# EAGLE board BMS-HVver3 (EAGLE 6.6.0), part 2 of 2
## Tracks (layer width: path | path; a pad name or v marks a point on that pad's centre or on a via) (continued)
N$56  (via drill 0.6) (continued)
  other vias: 1.92,102.02
N$57
  Top 0.61: D25.C 5.7,98.88 R156.2
N$58
  Top 0.178: R153.1 F2.2 | Q24.2 20,102.54 20.19,102.74
  Top 0.61: R156.1 7.82,98.9 7.92,99 7.92,101.62 R1.1 8.24,102.74 20.19,102.74 20.9,102.74 21.87,103.7 F2.2
N$59
  Top 0.178: Q24.1 20.23,99.5 20.37,99.36 25.85,99.36 R155.1
N$60
  Top 0.305: D26.A 2.12,94.53 R148.2
  Top 0.813: R148.2 2.1,96.38 2.95,97.22 9.7,97.22 12.9,100.42 17.87,100.42 Q24.3
N$61
  Top 0.305: D26.C R157.2
N$62  (via drill 0.6)
  Top 0.178: R152.1 28.63,97.2 v29.08,97.3
  Top 0.305: R157.1 R148.1
  Top 0.61: Q23.2 20.03,97.21 v20.02,97.22
  Top 0.813: R148.1 9.88,94.55 12.55,97.22 v20.02,97.22
  Bottom 0.61: F3.2 v29.08,97.3 20.98,97.3 20.9,97.22 v20.02,97.22
N$63
  Top 0.178: Q23.1 22.48,93.89 R159.1
N$64
  Top 0.305: D27.A 2.12,86.89 R189.2
  Top 0.813: R189.2 2.1,89.09 2.77,89.76 9.17,89.76 14.33,94.91 17.85,94.91 Q23.3
N$65
  Top 0.305: D27.C 5.98,83.79 R160.2
N$66
  Top 0.178: R158.1 19.99,86.3 Q22.2
  Top 0.305: R160.1 R189.1
  Top 0.813: F4.2 20.12,88.61 19.84,88.33 19.84,87.98 | 19.84,87.98 19.84,86.37 Q22.2 | R189.1 7.7,87.4 8.1,87.8 19.66,87.8 19.84,87.98
N$67
  Top 0.178: R162.1 20.01,84.42 Q22.1
N$68
  Top 0.305: D28.A 2.25,79.06 R190.2
  Top 0.813: R190.2 2.28,81.44 2.95,82.11 9.35,82.11 12.55,85.31 Q22.3
N$69
  Top 0.305: D28.C R163.2
N$70  (via drill 0.6)
  Top 0.178: R161.1 20.14,79.9 Q21.2
  Top 0.305: R163.1 7.89,78.16 8.28,78.56 8.28,78.69 R190.1
  Top 0.813: Q21.2 20.19,79.95 v20.19,81.4 20.02,81.22 11.3,81.22 9.17,79.09 R190.1
  Bottom 0.813: F5.2 20.9,79.98 20.19,80.69 v20.19,81.4
N$71
  Top 0.178: R165.1 20.29,77.72 Q21.1
N$72
  Top 0.305: D29.A 2.25,70.75 2.41,70.91 2.41,71.49 R191.2
  Top 0.813: R191.2 2.28,73.62 3.12,74.47 9.35,74.47 13.79,78.91 17.95,78.91 Q21.3
N$73
  Top 0.305: D29.C R166.2
N$74
  Top 0.178: R168.1 19.96,61.61 Q19.1
N$75
  Top 0.305: D30.A 2.25,56.17 2.41,56.33 2.41,56.73 R193.2
  Top 0.813: 2.41,56.73 2.41,58.82 3.12,59.53 9.35,59.53 12.19,62.38 17.67,62.38 Q19.3
N$76
  Top 0.305: R169.2 D30.C
N$77
  Top 0.178: Q20.2 21.23,68.56 R164.1
  Top 0.305: R166.1 R191.1
  Top 0.813: F6.2 20.19,71.09 19.84,70.73 | 19.84,70.73 19.66,70.55 19.66,68.62 Q20.2 | R166.1 7.89,71.23 8.1,71.44 19.13,71.44 19.84,70.73
N$78
  Top 0.178: Q20.1 21.44,66.66 R171.1
N$79
  Top 0.305: D31.A 2.25,64.12 R192.2
  Top 0.813: R192.2 2.28,66.15 3.12,67 10.06,67 10.77,67.71 17.52,67.71 Q20.3
N$80
  Top 0.305: D31.C R172.2
N$81  (via drill 0.6)
  Top 0.178: R170.1 19.66,64.51 v19.3,64.86
  Top 0.305: R172.1 R192.1
  Top 0.813: Q19.2 19.3,63.94 v19.3,64.86 19.13,64.69 7.75,64.69 7.89,64.55 R192.1
  Bottom 0.813: F7.2 31.32,62.45 30.51,63.26 20.9,63.26 v19.3,64.86
N$82
  Top 0.178: R167.1 21.48,53.56 F8.2
  Top 0.305: R169.1 R193.1
  Top 0.813: F8.2 20.48,53.6 20.1,53.22 | 20.1,53.22 20.02,53.13 20.02,51.35 Q18.2 | R169.1 7.89,56.65 7.92,56.69 18.06,56.69 19.48,55.26 19.48,53.84 20.1,53.22
N$83
  Top 0.178: Q18.1 21.46,49.41 R174.1
N$84
  Top 0.305: D32.A 2.25,49.37 R194.2
  Top 0.813: R194.2 2.28,51.57 2.77,52.06 12.01,52.06 13.79,50.28 17.8,50.28 Q18.3
N$85
  Top 0.305: D32.C R175.2
N$86  (via drill 0.6)
  Top 0.178: R173.1 20.37,44.52 Q17.2
  Top 0.305: R175.1 R194.1
  Top 0.813: Q17.2 20.37,44.52 v20.37,45.84 18.95,47.26 12.01,47.26 10.41,48.86 7.92,48.86 7.89,48.82 R175.1
  Bottom 0.813: F9.2 20.99,44.86 20.37,45.48 v20.37,45.84
N$87
  Top 0.178: R177.1 20.22,42.44 Q17.1
N$88
  Top 0.305: D33.A 2.25,41.72 R195.2
  Top 0.813: R195.2 2.28,43.93 2.95,44.59 12.01,44.59 13.26,43.35 18.05,43.35 Q17.3
N$89
  Top 0.305: D33.C R178.2
N$90
  Top 0.178: R176.1 21.48,36.05 F10.2
  Top 0.305: R178.1 R195.1
  Top 0.813: F10.2 20.59,36.1 20.19,35.7 20.19,35.53 | 20.19,35.53 20.19,33.67 Q15.2 | R178.1 7.89,41.26 7.75,41.39 14.68,41.39 16.82,39.26 16.82,36.24 17.35,35.7 20.02,35.7 20.19,35.53
N$91
  Top 0.178: R180.1 20.17,31.72 Q15.1
N$92
  Top 0.305: D34.A 2.25,34.25 R196.2
  Top 0.813: D34.A 2.25,36.25 2.77,36.77 13.08,36.77 14.5,35.35 14.5,33.57 15.39,32.68 Q15.3
N$93
  Top 0.305: D34.C R181.2
N$94  (via drill 0.6)
  Top 0.178: R179.1 20.19,27.42 Q14.2
  Top 0.305: R181.1 R196.1
  Top 0.813: Q14.2 20.19,27.42 v20.19,29.13 13.08,29.13 11.48,30.73 11.48,33.57 10.59,34.46 8.06,34.46 R196.1
  Bottom 0.813: F11.2 32.31,28.03 31.22,29.13 v20.19,29.13
N$95
  Top 0.178: R183.1 20.19,25.44 Q14.1
N$96
  Top 0.305: D35.A 2.25,26.79 R197.2
  Top 0.813: R197.2 2.28,28.82 2.95,29.48 10.95,29.48 13.97,26.46 18.03,26.46 Q14.3
N$97
  Top 0.305: D35.C R184.2
N$98
  Top 0.178: Q16.1 23.47,12.33 R186.1
N$99
  Top 0.254: D36.C 27.93,6.09 R187.2
N$100
  Top 0.178: R151.1 33.5,109.14
  Top 0.305: F1.2 33.5,110.27 33.5,109.14 34.6,109.14 35.31,108.42 35.31,102.02 32.28,99 32.28,89.22 32.68,88.83 R149.1 33.26,86.99 R150.1
  Top 0.61: F1.2 31.47,110.58 Q25.2
N$101
  Top 0.254: D36.A 24.07,9.29 R198.2
  Top 0.813: R198.2 21.26,9.39 20.02,10.63 20.02,13.22 Q16.3
N$102
  Top 0.254: R79.1 74.72,109.62 Q38.1
N$103
  Top 0.254: D8.A 53.03,102.02 R114.2
  Top 0.813: Q38.3 53.98,110.51 52.96,109.49 52.96,102.15 R114.2
N$104
  Top 0.254: D8.C 56.91,99.1 R81.2
N$105
  Top 0.178: U$14.1 34.87,13.39 R185.1
  Top 0.254: R187.1 29.65,9.31 R198.1
  Top 0.813: U$14.1 32.48,11.12 R188.1 32.3,11.17 30.33,11.17 29.57,10.41 R198.1
N$106
  Top 0.178: Q16.2 23.53,14.23 R182.1
  Top 0.305: R184.1 R197.1
  Top 0.813: F12.2 22.31,16.13 21.97,15.79 | 21.97,15.79 21.97,14.31 Q16.2 | 21.97,15.79 21.97,22.37 21.08,23.26 13.26,23.26 9.7,26.81 R197.1
N$107
  Top 0.61: R149.2 34.96,90.37 C64.1 35.1,90.58 35.1,91.66 35.61,92.17 43.05,92.17 43.35,91.88 U$28.P$2
N$108
  Top 0.178: R78.1 66.34,103.9 Q37.2
  Top 0.254: R81.1 58.64,102.03 R114.1
  Top 0.813: F14.2 66.29,106.06 66.04,105.81 66.04,104.79 | 66.04,104.79 66.04,103.82 Q37.2 | R114.1 58.66,104.27 59.06,104.67 65.91,104.67 66.04,104.79
N$109
  Top 0.305: D37.A R54.1
N$110
  Top 0.178: R80.1 67.6,101.78 67.82,102 66.42,102 66.29,101.87 66.29,101.75 66.17,101.62 66.17,102 66.04,102.13 66.04,101.92 Q37.1
N$111
  Top 0.254: D14.A 53.18,94.64 R115.2
  Top 0.813: R115.2 53.13,96.84 53.72,97.43 59.82,97.43 60.83,98.44 60.83,101.87 62.23,102.76 Q37.3
N$112
  Top 0.254: D14.C R82.2
N$113  (via drill 0.6)
  Top 0.178: R77.1 66.09,97.3 | 65.91,97.3 66.09,97.3 | 66.09,97.3 Q36.2
  Top 0.254: R82.1 58.76,94.65 R115.1
  Top 0.813: v66.67,98.95 66.55,98.95 66.04,98.44 66.04,98.32 | Q36.2 66.04,97.47 66.04,98.32 | 66.04,98.32 62.36,98.32 61.85,97.81 61.85,95.4 61.21,94.76 58.81,94.76 R115.1
  Bottom 0.813: F15.2 67.31,97.43 66.67,98.06 v66.67,98.95
N$114
  Top 0.305: Q26.3 43.64,50.05 R214.8 R214.7 R214.6 R214.5
N$115
  Top 0.178: Q36.1 67.61,95.46 R84.1
N$116
  Top 0.254: D15.A 53.08,83.97 53.08,87.14
  Top 0.813: R116.2 53.08,87.14 53.08,89.04 53.85,89.81 62.36,89.81 63.12,90.57 63.12,95.48 Q36.3
N$117
  Top 0.254: D15.C 56.77,83.91 56.77,83.84 56.94,83.84 | 57.15,83.84 56.94,83.84 | 56.94,83.84 R85.2
N$118
  Top 0.254: R83.1 66.15,86 Q35.2 | R85.1 58.67,83.97 58.67,86.5 58.68,86.5 R116.1
  Top 0.813: F16.2 66.42,88.66 66.17,88.41 66.17,87.9 | 66.17,87.9 66.17,85.95 Q35.2 | R116.1 58.68,87.4 59.18,87.9 66.17,87.9
N$119
  Top 0.178: Q26.1 44.59,56 R215.1 44.54,58.16 R213.1
N$120
  Top 0.178: D38.A 83.73,60.47 R55.1
N$121
  Top 0.254: R87.1 66.15,83.97 Q35.1
N$122
  Top 0.254: D16.A 53.08,76.09 R117.2
  Top 0.813: R117.2 53.08,81.16 53.85,81.93 61.21,81.93 61.98,82.69 61.98,84.47 62.48,84.98 Q35.3
N$123
  Top 0.178: 56.77,75.99 R88.2
  Top 0.254: D16.C 56.77,75.99 56.77,75.96
N$124  (via drill 0.6)
  Top 0.254: R86.1 66.32,80.33 66.32,80.13 | R88.1 58.68,76.09 R117.1
  Top 0.813: v66.42,81.42 66.42,80.66 | 66.42,80.66 66.42,80.23 66.32,80.13 Q34.2 | R117.1 58.68,79.65 58.93,79.9 59.31,79.9 59.82,80.41 66.17,80.41 66.42,80.66
  Bottom 0.813: F17.2 67.08,79.88 66.42,80.54 v66.42,81.42
N$125
  Top 0.406: J3.2 151.06,103.21 151,96.28 151,93.87 | 151,93.87 151,82.69 | 151,82.69 151,73.04 | 151,73.04 151,29.61 143.76,22.37 143.76,20.37 J4.2 | TX3.6 150.88,94 151,93.87 | TX1.6 151,82.69 | TX2.6 150.88,72.92 151,73.04
N$126
  Top 0.254: R90.1 66.15,77.87 Q34.1
N$127
  Top 0.254: D17.A 52.96,68.6 52.96,71.27 53.03,71.27 53.03,71.9 | R118.2 52.96,71.57 52.96,71.52
  Top 0.813: R118.2 53.03,71.9 53.03,73.75 53.72,74.44 61.21,74.44 62.36,75.58 62.36,78.5 62.87,79.01 Q34.3
N$128
  Top 0.178: R91.2 56.77,68.6
  Top 0.254: D17.C 56.77,68.6
N$129  (via drill 0.6)
  Top 0.406: J3.1 146.85,104.57 146.85,101.71 147.95,100.6 147.95,89.05 | 147.95,89.05 147.95,77.61 | 147.95,77.61 147.95,67.84 | 147.95,67.84 147.95,28.59 v143.76,24.4 | TX2.4 147.95,67.84 | TX1.4 147.95,77.61 | TX3.4 148.08,88.92 147.95,89.05
  Bottom 0.406: v143.76,24.4 145.8,22.37 145.8,20.41 J4.1
N$130
  Top 0.254: R93.1 66.02,61.49 Q32.1
N$131
  Top 0.305: D18.A 52.93,56.5 53.09,56.66 53,56.66 R120.2
  Top 0.813: R120.2 52.9,59.02 53.47,59.58 60.71,59.58 61.72,60.6 61.72,61.99 62.23,62.5 Q32.3
N$132
  Top 0.305: D18.C 56.52,53.74 56.64,53.87 56.68,53.87 R94.2
N$133  (via drill 0.3)
  Top 0.178: U3.35 38.8,70.52 38.53,70.25 38.53,69.56 v38.41,69.44
  Bottom 0.178: v38.41,69.44 38.41,69.03 38.08,68.7 37.3,68.7 C90.1
N$134
  Top 0.254: R91.1 58.67,68.6 58.67,71.39 58.63,71.39 R118.1 | R89.1 66.17,69.11 66.17,68.98 66.02,68.98 Q33.2
  Top 0.813: R118.1 58.73,71.57 58.93,71.77 66.08,71.77 F18.2 66.02,70.45 Q33.2
N$135  (via drill 0.3)
  Top 0.178: U1.35 129.7,70.52 v129.03,69.84
  Bottom 0.178: v129.03,69.84 127.61,69.84 C30.1
N$136
  Top 0.254: R96.1 66.02,66.95 Q33.1
N$137
  Top 0.305: D19.A 52.93,63.87 53.09,64.03 53.09,64.22 52.9,64.41
  Top 0.813: R119.2 52.9,64.41 52.9,66 53.72,66.82 60.83,66.82 61.85,67.84 63.8,67.84 Q33.3
N$138
  Top 0.305: D19.C R97.2
N$139  (via drill 0.6)
  Top 0.178: Q32.2 66.1,63.45 66.17,63.52
  Top 0.254: R95.1 66.17,63.52 65.66,63.52
  Top 0.305: R97.1 R119.1
  Top 0.813: R119.1 58.5,64.74 58.8,65.04 65.79,65.04 v65.91,65.17 66.02,65.06 Q32.2
  Bottom 0.813: v65.91,65.17 78.74,65.17 78.78,65.13 F19.2
N$140
  Top 0.254: D39.A 139.42,65.94 R56.1
N$141
  pour Top: 131.22,91.99 140.61,91.99 140.84,92.6 140.84,107.82 139.78,109.26 134.72,109.26 134.04,108.58 134.04,105.25 131.39,102.61 131.39,92.17
N$142
  Top 0.254: R92.1 67.31,51.48 67.31,51.2 66.29,51.2 66.29,51.07 66.28,51.07 Q31.2
  Top 0.305: R94.1 58.51,55.73 58.74,55.96
  Top 0.813: R120.1 58.5,56.2 58.74,55.96 58.8,55.9 62.36,55.9 63.12,55.14 63.12,53.36 63.25,53.23 66.42,53.23 | 66.42,53.23 66.59,53.23 F20.2 | Q31.2 66.28,53.09 66.42,53.23
N$144
  Top 0.254: R99.1 66.28,49.29 Q31.1
N$145
  Top 0.305: D20.A 52.8,49.4 52.78,49.42
  Top 0.813: R121.2 52.78,49.42 52.78,51.27 53.47,51.96 60.83,51.96 62.48,50.31 Q31.3
N$146
  Top 0.305: D20.C R100.2
N$147  (via drill 0.6)
  Top 0.254: R98.1 66.28,44.72 Q30.2
  Top 0.305: R100.1 58.38,48.66 | 58.38,48.66 58.38,49.51 58.67,49.8 58.67,48.91 58.55,48.79 | 58.38,48.79 58.38,48.66
  Top 0.813: R121.1 58.38,48.79 58.38,48.58 58.55,48.41 60.58,48.41 61.47,47.52 65.79,47.52 66.29,47.01 v66.29,46.5 66.28,46.48 Q30.2
  Bottom 0.813: v66.29,46.5 66.29,45.36 66.67,44.98 77.76,44.98 F21.2
N$149
  Top 0.254: R102.1 66.28,42.69 Q30.1
N$150
  Top 0.305: D21.A 52.93,41.84 52.58,42.18 52.58,42.05 R122.2
  Top 0.813: R122.2 52.9,44.03 53.47,44.59 63.29,44.59 Q30.3
N$151
  Top 0.305: D21.C R103.2
N$152
  Top 0.254: Q28.2 67.44,33.73 67.44,33.67 67.6,33.67 R101.1
  Top 0.305: R103.1 R122.1
  Top 0.813: R122.1 58.5,40.7 58.67,40.53 63.63,40.53 64.52,39.64 64.52,36.47 65.15,35.83 66.29,35.83 | 66.29,35.83 F22.2 | Q28.2 66.28,35.82 66.29,35.83
N$154
  Top 0.254: Q28.1 67.68,31.83 R105.1
N$155
  Top 0.305: D22.A 53.05,33.83 52.96,33.93 53.09,34.05 53.09,34.5 53.03,34.56
  Top 0.813: R123.2 53.03,34.56 53.03,36.28 53.72,36.98 61.72,36.98 62.61,36.09 62.61,33.16 62.99,32.78 64.05,32.76 Q28.3
N$156
  Top 0.305: D22.C R106.2
N$159  (via drill 0.6)
  Top 0.178: R104.1 66.41,27.7 66.28,27.83
  Top 0.305: R106.1 58.64,33.79 58.63,33.8
  Top 0.813: R123.1 58.63,33.8 58.63,33.34 58.67,33.29 60.71,33.29 61.21,32.78 61.21,29.86 61.85,29.23 v66.29,29.23 66.28,29.21 66.28,27.83 Q27.2
  Bottom 0.813: 66.29,28.96 v66.29,29.23 68.2,27.32 F23.2
N$161
  Top 0.254: R108.1 66.28,25.67 Q27.1
N$162
  Top 0.254: D23.A 53.09,23.77 53.09,26.81 53.03,26.81 R124.2
  Top 0.813: R124.2 53.03,28.54 53.72,29.23 59.94,29.23 62.48,26.69 Q27.3
N$163
  Top 0.254: D23.C R109.2
N$165
  Top 0.254: Q29.1 66.93,14.18 66.93,14.24 67.18,14.24 67.18,13.86 R111.1
N$166
  Top 0.254: D24.C R112.2
N$170
  Top 0.254: R75.1 77.85,104.79 80.39,107.33 80.39,111.14 79.12,112.41 76.2,112.41 76.07,112.54 76.07,113.57 F13.2 | R76.1 74.72,111.4 74.55,111.57
  Top 0.406: R75.1 79.55,94.52 R74.1
  Top 0.813: F13.2 74.85,113.61 74.55,113.3 74.55,111.57 Q38.2
N$175
  Top 0.254: D24.A 53.16,16.27 53.16,19.45
  Top 0.813: R125.2 53.16,19.45 53.16,21.3 53.85,21.99 60.58,21.99 60.83,21.73 60.83,16.4 61.72,15.51 64.43,15.51 Q29.3
N$176
  Top 0.254: R110.1 U$40.1
  Top 0.813: R125.1 58.76,18.35 58.93,18.18 58.93,16.44 | 58.93,16.44 R112.1 | 58.93,16.44 58.93,12.21 60.2,10.94 77.64,10.94 R113.1 80.23,11.16 U$40.1
N$177
  Top 0.254: R107.1 66.91,16.15 Q29.2 | R109.1 58.63,23.77 58.63,25.93
  Top 0.813: R124.1 58.63,25.93 58.63,25.84 58.8,25.67 61.34,25.67 62.36,24.66 62.36,19.58 63.25,18.69 66.71,18.69 F24.2 66.91,18.49 Q29.2
N$178
  Top 0.254: U$29.P$2 90.31,87.75 C21.1
  Top 0.406: R74.2 79.63,91.74 80.03,91.33 89.56,91.33 90.27,90.62 90.27,89.72 U$29.P$2
N$192
  Top 0.229: Q39.3 92.46,56.3 R139.8 92.42,55.56 92.46,55.52 92.46,55.45 R139.7 R139.6 R139.5
N$193
  Top 0.178: R138.1 93.34,61.61 | 93.34,61.61 93.31,61.61 R140.1 | Q39.1 93.41,61.55 93.34,61.61
N$262
  Top 0.813: F12.1 25.23,18.57 U$15.1
N$264
  Bottom 0.813: F11.1 36.07,27.42 U$16.1
N$286
  Top 0.813: F10.1 25.23,36.1 U$17.1
N$287
  Bottom 0.406: 36.11,44.89 U$18.1
  Bottom 0.813: F9.1 36.11,44.86 U$18.1
N$288
  Top 0.813: F8.1 25.23,53.6 U$19.1
N$289
  Bottom 0.813: F7.1 36.04,62.45 U$20.1
N$290
  Top 0.813: F6.1 25.22,71.09 U$21.1
N$291
  Bottom 0.813: F5.1 36.02,79.98 U$22.1
N$292
  Top 0.813: F4.1 U$23.1
N$293
  Bottom 0.813: F3.1 36.04,97.3 U$24.1
N$294
  Top 0.813: F2.1 24.89,103.7 25.35,104.16 25.35,106.04 U$25.1
N$295
  Top 0.61: F1.1 34.89,113.62 U$26.1
N$296
  Top 0.813: F24.1 70.61,18.56 U$41.1
N$297
  Bottom 0.813: F23.1 81.48,27.32 U$42.1
N$298
  Top 0.813: F22.1 70.38,35.83 U$43.1
N$299
  Bottom 0.813: F21.1 U$44.1
N$300
  Top 0.813: F20.1 70.66,53.61 U$45.1
N$301
  Bottom 0.813: U$46.1 79.86,62.36 F19.1
N$302
  Top 0.813: F18.1 70.66,71.14 U$47.1
N$303
  Bottom 0.813: F17.1 U$48.1
N$304
  Top 0.813: U$49.1 68.31,88.64 F16.1
N$305
  Bottom 0.813: F15.1 81.46,97.43 U$50.1
N$306
  Top 0.813: F14.1 70.61,106.06 U$51.1
N$307
  Top 0.813: U$52.1 F13.1
N$308
  Top 0.813: F36.1 116.17,18.55 U$2.1
N$309
  Bottom 0.813: F35.1 126.87,27.35 U$3.1
N$310
  Top 0.813: F34.1 116.03,36.09 U$4.1
N$311
  Bottom 0.813: F33.1 126.87,44.85 U$5.1
N$312
  Top 0.813: F32.1 116.05,53.61 U$6.1
N$313
  Bottom 0.813: U$7.1 F31.1
N$314
  Top 0.813: F30.1 U$8.1
N$315
  Bottom 0.813: U$9.1 124.7,79.88 F29.1
N$316
  Top 0.813: F28.1 116,88.66 U$10.1
N$317
  Bottom 0.813: F27.1 126.9,97.4 U$11.1
N$318
  Top 0.813: F26.1 U$12.1
N$319
  Top 0.813: F25.1 125.65,113.61 U$13.1
S1
  Top 0.178: U2.25 85.46,64.91 85.22,64.66 78.36,64.66 77.98,64.28 77.98,18.18 73.79,13.99 70.32,13.99 R111.2
S2
  Top 0.178: U2.23 77.43,65.89 77.09,65.55 77.09,28.34 74.14,25.39 69.71,25.39 R108.2
S3
  Top 0.178: U2.21 76.65,66.89 76.33,66.57 76.33,33.42 74.8,31.89 69.61,31.89 R105.2
S4
  Top 0.178: U2.19 75.87,67.89 75.56,67.58 75.56,44.47 73.79,42.69 R102.2
S5
  Top 0.178: U2.17 75.09,68.89 74.8,68.6 74.8,50.95 73.15,49.29 R99.2
S6
  Top 0.178: U2.15 74.44,69.89 74.04,69.49 74.04,62.88 72.64,61.49 R93.2
S7
  Top 0.178: U2.13 73.79,70.89 73.28,70.38 73.28,67.96 72.26,66.95 R96.2
S8
  Top 0.178: U2.11 73.42,71.89 72.9,72.41 72.9,76.98 72.01,77.87 R90.2
S9
  Top 0.178: U2.9 73.94,72.89 73.79,73.04 73.79,83.08 72.77,84.09 69.56,84.09 R87.2
S10
  Top 0.178: U2.7 74.85,73.89 74.68,74.06 74.68,94.38 73.66,95.4 R84.2
S11
  Top 0.178: U2.5 75.62,74.89 75.44,75.08 75.44,100.73 74.3,101.87 69.43,101.87 R80.2
S12
  Top 0.178: U2.3 76.4,75.89 76.2,76.09 76.2,105.94 77.85,107.59 R79.2
S13
  Top 0.178: R7.2 123.3,78.47 122.66,77.82 122.66,76.29 122.94,76.02 U1.3 | U1.3
S14
  Top 0.178: U1.5 122.71,75.02 121.87,75.86 121.87,78.12 122.56,78.81 122.56,98.77 122.12,99.2 118.33,99.2 R8.2
S15
  Top 0.178: R12.2 121.28,93.36 121.79,92.86 121.79,79.14 121.08,78.43 121.08,75.53 122.58,74.03 124,74.03 124.03,74.01 U1.7
S16
  Top 0.178: R15.2 120.37,83.97 120.98,83.38 120.98,79.44 120.29,78.76 120.29,75.25 122.53,73.02 U1.9
S17
  Top 0.178: R18.2 119.1,76.6 119.51,76.19 119.51,74.9 122.38,72.03 124.18,72.03 U1.11
S18
  Top 0.178: U1.15 120.26,70.02 117.53,67.28 117.53,60.75 117.02,60.24 115.81,60.24 R21.2
S19
  Top 0.178: U1.13 119.87,71.02 116.56,67.71 116.56,66.84 116.41,66.69 R24.2
S20
  Top 0.178: U1.17 120.69,69.02 118.49,66.82 118.49,50.49 117.12,49.12 115.07,49.12 R27.2
S21
  Top 0.178: U1.19 121.06,68.02 119.48,66.44 119.48,44.95 117.22,42.69 R30.2 114.96,42.69 114.94,42.72 115.24,42.72 115.29,42.77
S22
  Top 0.178: U1.21 121.53,67.02 120.45,65.93 120.45,33.6 118.8,31.95 115.38,31.95 R33.2
S23
  Top 0.178: U1.23 123.82,66.02 123.8,66.03 122,66.03 121.44,65.47 121.44,27.17 119.63,25.37 115.85,25.37 115.65,25.57 115.65,25.44 115.72,25.37 115.58,25.37 R36.2
S24
  Top 0.178: U1.25 131.03,64.98 130.68,64.64 122.99,64.64 122.33,63.98 122.33,15.16 119.38,12.21 R39.2
S25
  Top 0.178: U3.3 31.09,76.02 30.86,76.24 30.86,101.85 31.39,102.38 31.39,105.01 R154.2
S26
  Top 0.178: U3.5 30.31,75.02 29.97,75.35 29.97,98.65 29.26,99.36 27.7,99.36 R155.2
S27
  Top 0.178: U3.7 29.36,74.02 29.08,74.29 29.08,92.96 28.19,93.85 24.27,93.85 R159.2
S28
  Top 0.178: U3.9 28.53,73.02 28.25,73.3 28.25,83.84 27.66,84.42 R162.2
S29
  Top 0.178: U3.11 27.57,72.02 27.57,72.07 27.3,72.33 27.3,77.13 26.77,77.67 24.12,77.67 R165.2
S30
  Top 0.178: U3.15 29.26,70.02 28.91,69.67 28.91,63.09 27.36,61.54 23.25,61.54 R168.2
S31
  Top 0.178: U3.13 28.21,71.02 28.02,70.82 28.02,67.53 27.1,66.62 R171.2
S32
  Top 0.178: U3.17 30.21,69.02 29.79,68.6 29.79,52.24 26.95,49.4 R174.2
S33
  Top 0.178: U3.19 30.99,68.02 30.68,67.71 30.68,43 30.15,42.46 23.43,42.46 R177.2
S34
  Top 0.178: U3.21 31.59,67.02 31.39,66.82 31.39,34.82 28.3,31.72 R180.2
S35
  Top 0.178: U3.23 32.37,66.02 32.11,65.75 32.11,29.3 28.25,25.44 R183.2
S36
  Top 0.178: U3.25 38.71,65.52 38.24,65.04 33.17,65.04 32.82,64.69 32.82,27.7 29.62,24.5 29.62,14.19 27.84,12.41 R186.2
SWTEN
  Top 0.178: U2.36 89.35,70.89 SJ10.1
SWTEN1
  Top 0.254: U1.36 132.34,71.02 133.32,72 134.76,72 SJ5.1
SWTEN2
  Top 0.178: U3.36 44.62,71.02 SJ15.1
V+
  Top 0.254: R75.2 C20.1 79.11,87.79 79.5,87.39 79.5,79.9 78.61,79.01 U2.1
V+1
  Top 0.178: R3.2 125.17,100.3 124.97,100.09 125.09,100.09 125.09,100.04 | 125.09,100.04 125.09,77.13 124.97,77 124.28,77 U1.1 | C1.1 125.2,99.94 125.09,100.04
V+2
  Top 0.178: U3.1 31.87,77.02 31.75,77.13 31.75,83.43 32.08,83.76 33.36,83.76 C63.1
  Top 0.305: R150.2 C63.1
VREF1
  Top 0.229: U2.35 87.62,70.39 88.52,69.49 88.61,69.49 C58.1
VREF2
  Top 0.229: U2.34 86.72,69.89 89.53,67.2 89.53,63.9 90.17,63.26 91.57,63.26 91.69,63.14 91.52,63.14 C59.1 91.48,63.18 R140.2 91.51,61.71 Q39.2
VREF4  (via drill 0.3)
  Top 0.254: U1.34 132.35,70.02 v132.69,70.35 | v136.22,57.95 137.41,57.95 C31.1 137.61,57.92 R68.2 137.63,56.18 Q13.2
  Bottom 0.254: v132.69,70.35 133.81,70.35 134.29,69.87 134.29,58.67 135.03,57.93 136.19,57.93 v136.22,57.95
VREF6  (via drill 0.3)
  Top 0.178: 46.79,57.19 v47.14,56.84
  Top 0.254: U3.34 44.63,70.02 46.89,67.76 46.89,57.09 v47.14,56.84 | v41.66,56.33 42.56,56.33 R215.2
  Top 0.406: C91.1 42.86,56.07 R215.2 42.84,54.56 Q26.2
  Bottom 0.254: v47.14,56.84 42.16,56.84 v41.66,56.33
VREG  (via drill 0.3)
  Top 0.178: U2.40 85.44,72.92 84.33,72.92 84.07,72.66 84.07,71.77 84.46,71.39 U2.37 | R55.2 85.79,62.51 v85.95,62.68
  Top 0.229: U2.37 87.76,71.39 88.14,71.77 89.34,71.77 SJ10.2 92.4,71.97 92.46,71.9 92.32,71.9 C60.1 94.02,71.68 C61.1
  Top 0.254: SJ6.1 88.34,84.65 v88.27,84.73 88.14,84.85 88.14,85.87 88.65,86.38 92.08,86.38 92.46,86.76 92.46,89.3 92.61,89.45 U$29.P$3 | v88.27,82.06 89.89,82.06 SJ7.1 | SJ8.1 v88.27,79.39 | SJ9.1 v88.65,76.85
  Top 0.305: v89.36,73.32 89.36,72.02 SJ10.2
  Bottom 0.178: v85.95,62.68 87.94,62.68 88.21,62.96 88.21,72.18 v89.36,73.32
  Bottom 0.254: v88.27,84.73 v88.27,82.06 v88.27,79.39 88.39,79.39 88.65,79.14 v88.65,76.85
  Bottom 0.305: v89.36,73.32 89.36,76.14 v88.65,76.85
VREG1  (via drill 0.3)
  Top 0.178: C5.1 139.42,73.09 139.57,73.25
  Top 0.254: 134.72,73.02 U1.40 129.94,73.02 129.74,72.81 129.74,71.65 129.87,71.52 U1.37 | 134.72,73.02 SJ5.2 137.37,72.93 C32.1 139.41,73.09 C5.1 | 134.72,73.02 136.12,73.02 136.14,72.99 v136.14,73.25 | R56.2 139.37,69.11 139.62,69.36 v140.44,69.36
  Top 0.305: SJ1.1 v134.44,85.34 | v134.44,82.72 135.87,82.72 SJ2.1 | SJ3.1 v134.67,80.26 | SJ4.1 135.05,77.72 v135.03,77.69 | U$30.P$3 139.22,87.3 v138.91,86.99
  Bottom 0.254: v140.44,69.36 137.24,69.36 135.97,70.63 135.97,73.07 v136.14,73.25
  Bottom 0.305: v138.91,86.99 134.87,86.99 134.47,86.58 134.47,85.36 v134.44,85.34 v134.44,82.72 134.67,82.49 v134.67,80.26 135.03,79.9 v135.03,77.69 135.05,77.67 135.05,76.37 136.14,75.28 v136.14,73.25
VREG2  (via drill 0.3)
  Top 0.254: U3.40 42.83,73.02 | 42.83,73.02 43.33,72.53 43.33,72.28 | 43.33,72.28 43.33,71.95 42.88,71.52 U3.37 | SJ15.2 44.78,72.2 | 44.78,72.2 43.42,72.2 43.33,72.28 | C93.1 C92.1 47.18,72.34 47.02,72.18 44.8,72.18 44.78,72.2 | 42.83,73.02 42.85,73.02 v43.31,72.56
  Top 0.305: R54.2 48.62,66.77 v48.59,66.8
  Top 0.406: v42.57,82.11 44.22,82.11 SJ12.1 | SJ13.1 v42.9,79.42 | SJ14.1 v43.36,76.7
  Top 0.61: SJ11.1 v42.52,84.85 | U$28.P$3 45.65,89.12 v44.83,88.31
  Bottom 0.254: v43.31,72.56 43.31,76.55 v43.36,76.7
  Bottom 0.305: v48.59,66.8 48.59,72.13 47.85,72.86 43.61,72.86 v43.31,72.56
  Bottom 0.406: v42.52,84.85 42.52,82.16 v42.57,82.11 42.9,81.78 v42.9,79.42 43.16,79.16 43.16,76.93 43.36,76.73 v43.36,76.7
  Bottom 0.61: v44.83,88.31 43.38,88.31 42.52,87.44 v42.52,84.85

## Text on the board
tNames: BMS - HV | V2 2017